# EasyEDA Pro project RN8302B-c8t6 V3.1.eprj, schematic Schematic1 (continued)
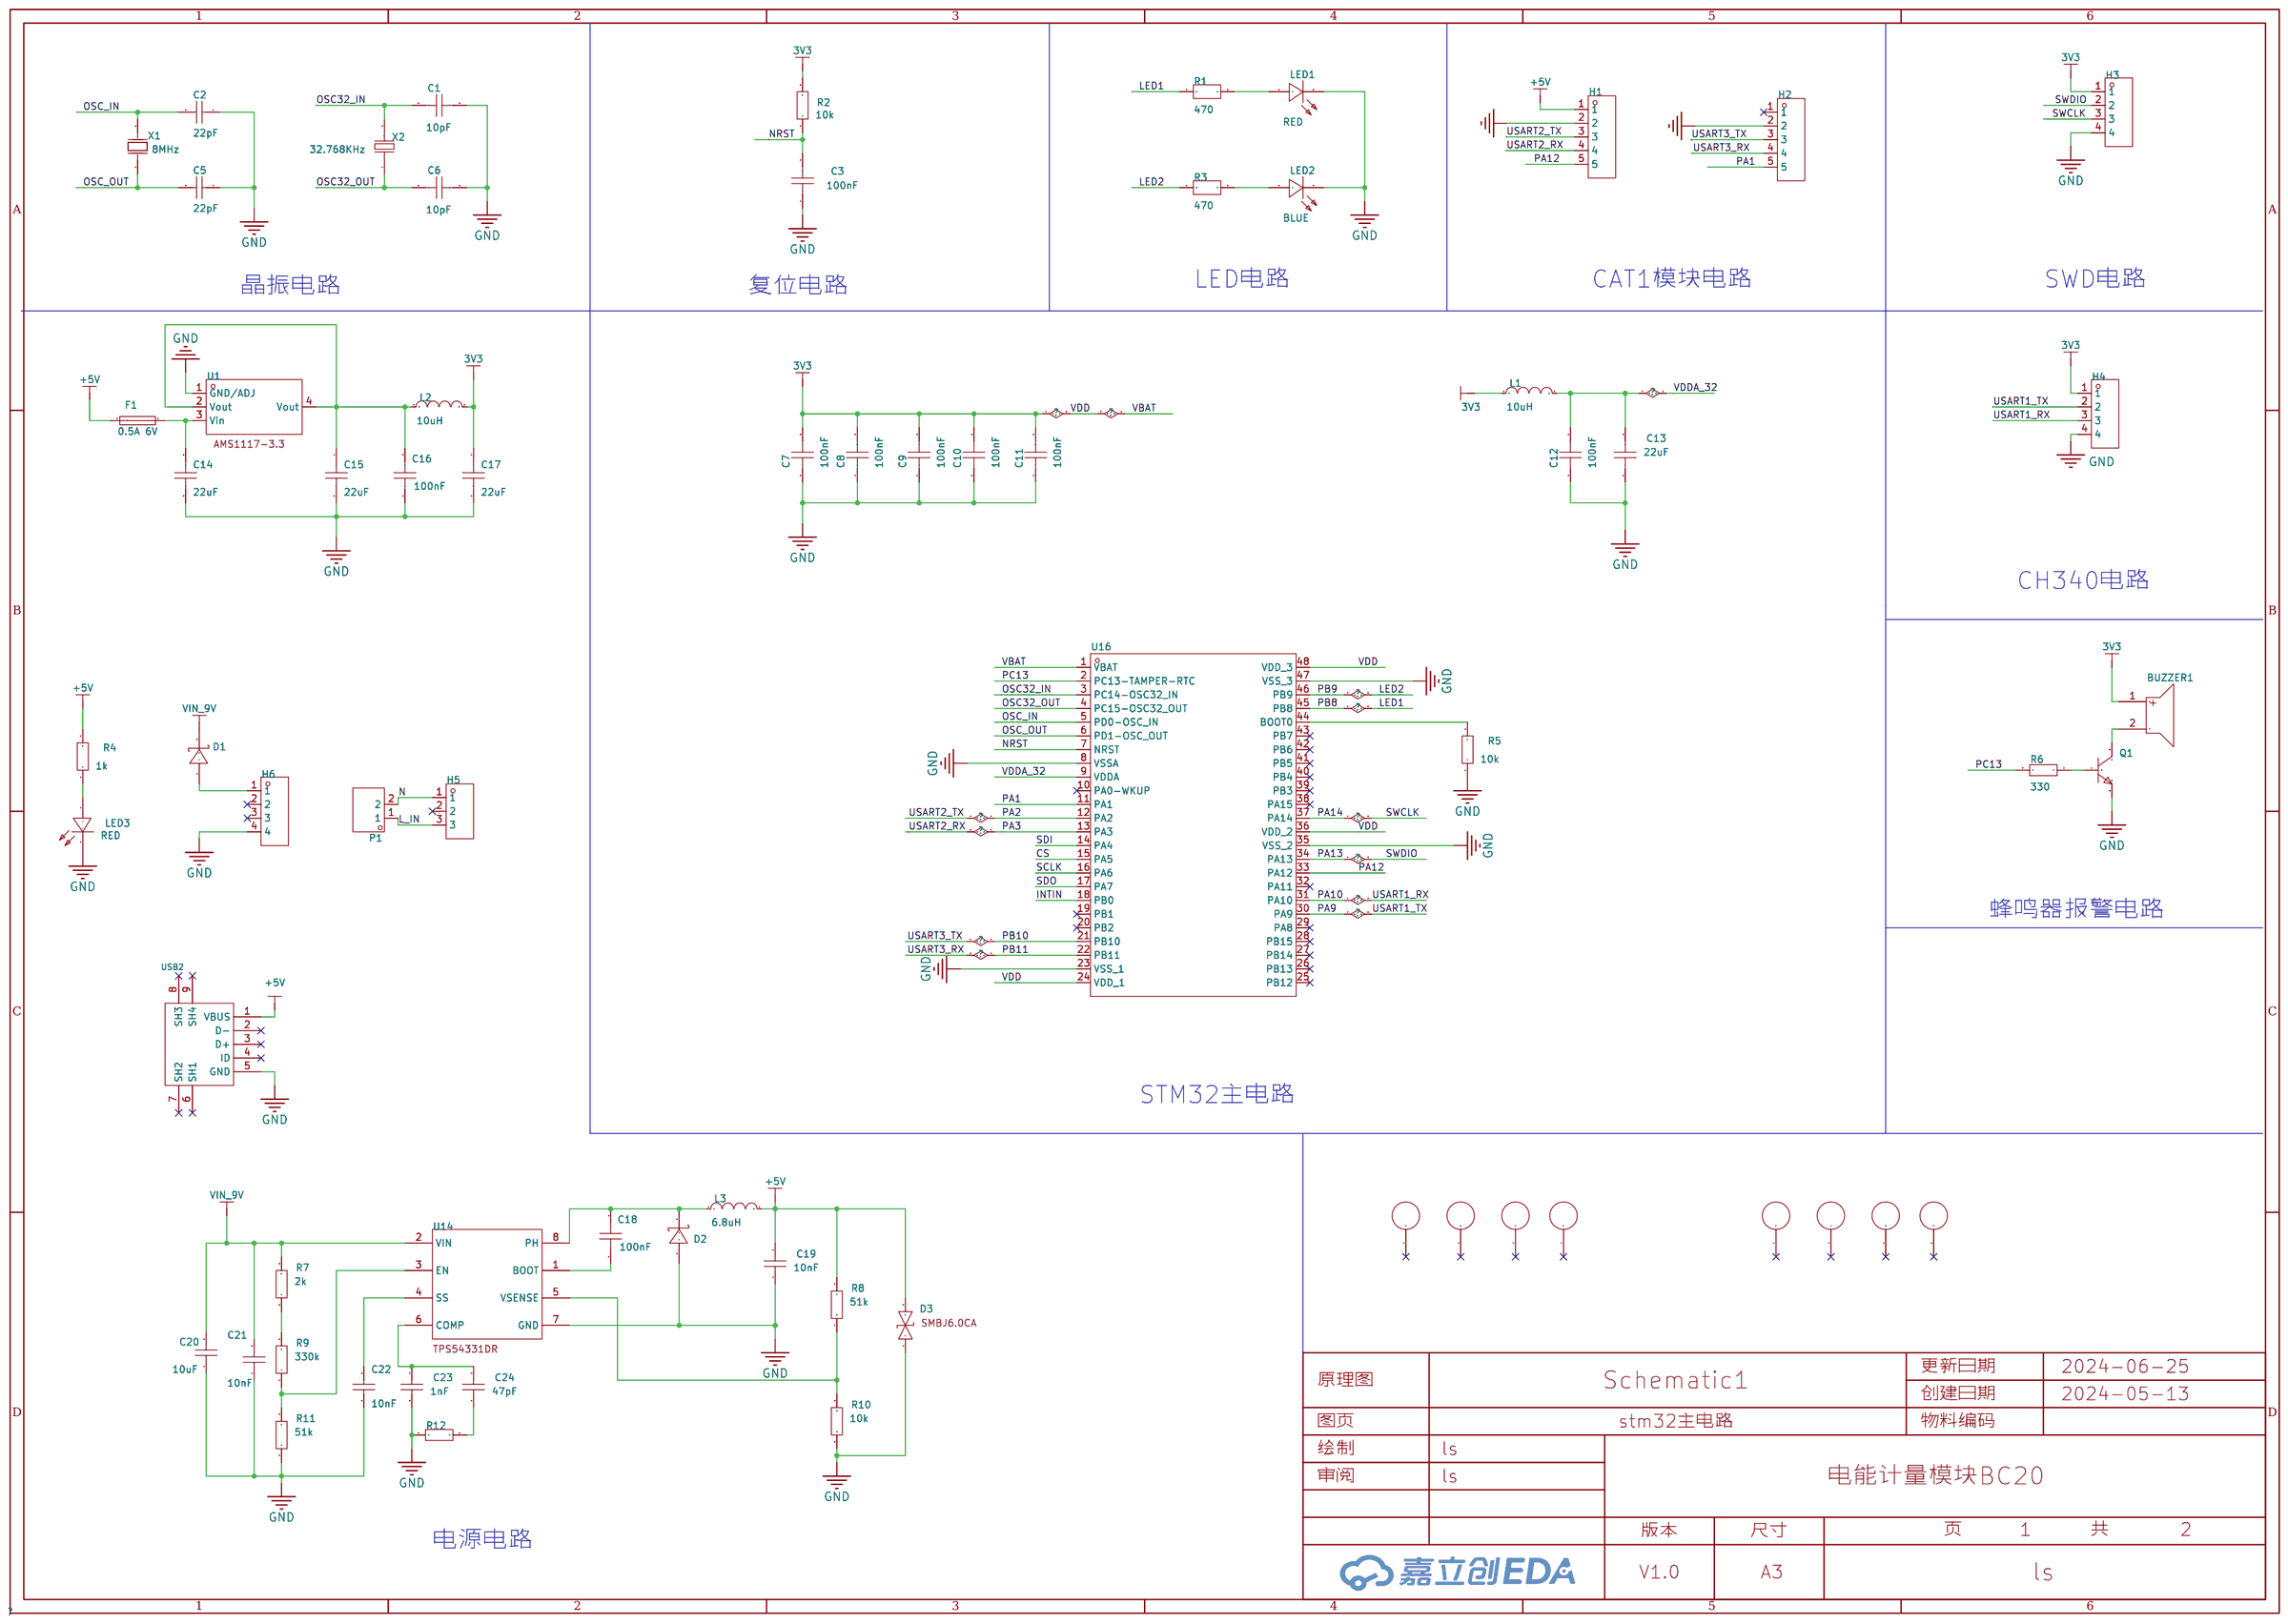
[diagram p0: stm32主电路]
## Library data of the parts (continued)
R32-R37 R42-R47 R52-R57 = 0603WAF3302T5E: 电阻类型:厚膜电阻;阻值:33kΩ;精度:±1%;功率:100mW;最大工作电压:75V;温度系数:±100ppm/℃;; LCSC Part Name: 33kΩ ±1% 100mW 厚膜电阻; Supplier Part: C4216; Manufacturer: UNI-ROYAL(厚声); Supplier Footprint: 0603; JLCPCB Part Class: 基础库; Datasheet: https://atta.szlcsc.com/upload/public/pdf/source/20200306/C422600_1E6D84923E4A46A82E41ADD87F860B5C.pdf; Supplier: LCSC; Type: 厚膜电阻; Tolerance: ±1%; Power(Watts): 100mW; Overload Voltage (Max): 75V; Temperature Coefficient: ±100ppm/℃; Operating Temperature Range: -55℃~+155℃
R38 R39 R48 R49 R58 R59 = 0603WAF499JT5E: 电阻类型:厚膜电阻;阻值:49.9Ω;精度:±1%;功率:100mW;最大工作电压:75V;温度系数:±100ppm/℃;; LCSC Part Name: 49.9Ω ±1% 100mW 厚膜电阻; Supplier Part: C23185; Manufacturer: UNI-ROYAL(厚声); Supplier Footprint: 0603; JLCPCB Part Class: 基础库; Datasheet: https://atta.szlcsc.com/upload/public/pdf/source/20200306/C422600_1E6D84923E4A46A82E41ADD87F860B5C.pdf; Supplier: LCSC; Type: 厚膜电阻; Tolerance: ±1%; Power(Watts): 100mW; Overload Voltage (Max): 75V; Temperature Coefficient: ±100ppm/℃; Operating Temperature Range: -55℃~+155℃
U17 = RN8302B: Supplier Part: C84227; Manufacturer: 锐能微; Supplier Footprint: LQFP-44(10x10); JLCPCB Part Class: 扩展库; Datasheet: https://atta.szlcsc.com/upload/public/pdf/source/20230411/DF1CD6921FB40C40BE8810E1BF055CC2.pdf; Supplier: LCSC
X5 = X49SD8192MSD2SC-1: 晶振类型:直插晶振;频率:8.192MHz;常温频差:±20ppm;外接负载电容:20pF;频率稳定度(全温):±30ppm;; LCSC Part Name: 8.192MHz ±20ppm 20pF; Supplier Part: C34693; Manufacturer: YXC(扬兴晶振); Supplier Footprint: HC-49S; JLCPCB Part Class: 扩展库; Datasheet: https://atta.szlcsc.com/upload/public/pdf/source/20240329/977D7F2434F98B2BE33270BB9FF3D86D.pdf; Supplier: LCSC; Crystal Type: 直插晶振; Normal temperature Frequency Tolerance: ±20ppm; External load capacitor: 20pF; Frequency Stability(Full temperature range): ±30ppm; Operating Temperature: -20℃~+70℃
BUZZER1 = KXG0903C3: LCSC Part Name: 蜂鸣器; Supplier Part: C1122357; Manufacturer: KINGSTATE(志丰电子); Supplier Footprint: 插件; JLCPCB Part Class: Extended Part; Datasheet: https://atta.szlcsc.com/upload/public/pdf/source/20210414/C1122357_7DD89FF41C555C0A4D62A25698007102.pdf; Supplier: LCSC
C1 C6 = C2012C0G1H100DT000N: 容值:10pF;精度:±0.5pF;额定电压:50V;温度系数:C0G;; LCSC Part Name: 10pF ±0.5pF 50V; Supplier Part: C338017; Manufacturer: TDK; Supplier Footprint: 0805; JLCPCB Part Class: Extended Part; Datasheet: https://atta.szlcsc.com/upload/public/pdf/source/20181129/C338017_E805D6379BA539BB4F11BE0C94AD5704.pdf; Supplier: LCSC; Tolerance: ±0.5pF; Voltage Rated: 50V; Temperature Coefficient: C0G
C2 C5 = 0805N220J500CT: 容值:22pF;精度:±5%;额定电压:50V;温度系数:NP0;; LCSC Part Name: 22pF ±5% 50V; Supplier Part: C123642; Manufacturer: 华新科(Walsin); Supplier Footprint: 0805; JLCPCB Part Class: Extended Part; Datasheet: https://atta.szlcsc.com/upload/public/pdf/source/20200728/C123642_830473AA93168237E1ABA8D018761BF6.pdf; Supplier: LCSC; Tolerance: ±5%; Voltage Rated: 50V; Temperature Coefficient: NP0
C3 C7-C12 C16 C18 = C0805B104K500NT: 容值:100nF;精度:±10%;额定电压:50V;温度系数:X7R;; LCSC Part Name: 100nF ±10% 50V; Supplier Part: C476766; Manufacturer: TORCH(火炬); Supplier Footprint: 0805; JLCPCB Part Class: Extended Part; Datasheet: https://atta.szlcsc.com/upload/public/pdf/source/20191230/C476766_171E30D5B7F7164A8210B8E948DFBAE0.pdf; Supplier: LCSC; Tolerance: ±10%; Voltage Rated: 50V; Temperature Coefficient: X7R
C13-C15 C17 = CL21A226MOCLRNC: 容值:22uF;精度:±20%;额定电压:16V;温度系数:X5R;; LCSC Part Name: 22uF ±20% 16V; Supplier Part: C398815; Manufacturer: SAMSUNG(三星); Supplier Footprint: 0805; JLCPCB Part Class: Extended Part; Datasheet: https://atta.szlcsc.com/upload/public/pdf/source/20190620/C398815_20AAFF598B03288BF85DE788BB79EE78.pdf; Supplier: LCSC; Tolerance: ±20%; Voltage Rated: 16V; Temperature Coefficient: X5R
C19 C21 C22 = CC0603KRX7R9BB103: 容值:10nF;精度:±10%;额定电压:50V;温度系数:X7R;; LCSC Part Name: 10nF ±10% 50V; Supplier Part: C100042; Manufacturer: YAGEO(国巨); Supplier Footprint: 0603; JLCPCB Part Class: Extended Part; Datasheet: https://atta.szlcsc.com/upload/public/pdf/source/20180326/C100042_E8B0111D51DE3671A0A4A59FBCEFE81C.pdf; Supplier: LCSC; Tolerance: ±10%; Voltage Rated: 50V; Temperature Coefficient: X7R
C20 = CL31A106KBHNNNE: 容值:10uF;精度:±10%;额定电压:50V;温度系数:X5R;; LCSC Part Name: 10uF ±10% 50V; Supplier Part: C13585; Manufacturer: SAMSUNG(三星); Supplier Footprint: 1206; JLCPCB Part Class: Basic Part; Datasheet: https://atta.szlcsc.com/upload/public/pdf/source/20160103/1457707668742.pdf; Supplier: LCSC; Tolerance: ±10%; Voltage Rated: 50V; Temperature Coefficient: X5R
C23 = CC0402KRX7R9BB102: 容值:1nF;精度:±10%;额定电压:50V;温度系数:X7R;; LCSC Part Name: 1nF ±10% 50V; Supplier Part: C106205; Manufacturer: YAGEO(国巨); Supplier Footprint: 0402; JLCPCB Part Class: Extended Part; Datasheet: https://atta.szlcsc.com/upload/public/pdf/source/20171226/C106205_15142609593391205665.pdf; Supplier: LCSC; Tolerance: ±10%; Voltage Rated: 50V; Temperature Coefficient: X7R
C24 = CC0402JRNPO9BN470: 容值:47pF;精度:±5%;额定电压:50V;温度系数:NP0;; LCSC Part Name: 47pF ±5% 50V; Supplier Part: C60137; Manufacturer: YAGEO(国巨); Supplier Footprint: 0402; JLCPCB Part Class: Extended Part; Datasheet: https://atta.szlcsc.com/upload/public/pdf/source/20151203/1457707608387.pdf; Supplier: LCSC; Tolerance: ±5%; Voltage Rated: 50V; Temperature Coefficient: NP0
D1 = SS210_1: 直流反向耐压(Vr):100V;平均整流电流(Io):2A;正向压降(Vf):850mV@2A;; LCSC Part Name: 100V 2A 850mV@2A; Supplier Part: C14996; Manufacturer: MDD; Manufacturer Part: SS210; Supplier Footprint: SMA(DO-214AC); JLCPCB Part Class: Basic Part; Datasheet: https://atta.szlcsc.com/upload/public/pdf/source/20190304/C14996_C9642665EC53B919CC87DB9E28DB3D1C.pdf; Supplier: LCSC; Reverse Voltage (Vr): 100V; Average Rectified Current (Io): 2A; Forward Voltage (Vf@If): 850mV@2A
D2 = SR34_R1_00001: 直流反向耐压(Vr):40V;平均整流电流(Io):3A;正向压降(Vf):500mV@3A;; LCSC Part Name: 40V 3A 500mV@3A; Supplier Part: C282386; Manufacturer: PANJIT(强茂); Supplier Footprint: SMB(DO-214AA); JLCPCB Part Class: Extended Part; Datasheet: https://atta.szlcsc.com/upload/public/pdf/source/20190416/C282386_4851096806C28D424AA72EA535C70F53.pdf; Supplier: LCSC; Reverse Voltage (Vr): 40V; Average Rectified Current (Io): 3A; Forward Voltage (Vf@If): 500mV@3A
D3 = SMBJ6.0CA: 极性:双向;反向截止电压(Vrwm):6V;击穿电压(最小值):6.67V;峰值脉冲电流(Ipp)@10/1000s:58.3A;最大钳位电压:10.3V;; LCSC Part Name: 双向 6V; Supplier Part: C693504; Manufacturer: FTR(乔光电子); Supplier Footprint: SMB(DO-214AA); JLCPCB Part Class: Extended Part; Datasheet: https://atta.szlcsc.com/upload/public/pdf/source/20200701/C693490_2A1922FF33BB98835C22E740F3EF18EC.pdf; Supplier: LCSC; Polarity: 双向; Reverse Stand-Off Voltage (Vrwm): 6V; Breakdown Voltage (Min): 6.67V; Peak Pulse Current (Ipp)@10/1000μs: 58.3A; Maximum Clamping Voltage: 10.3V
F1 = SMD0805P050TF: 最大电压:6V;最大电流:100A;保持电流:500mA;跳闸电流:1A;消耗功率:500mW;初始态阻值(最小值):150m;跳断后阻值(最大值):850m;最大动作时间:1.5s;工作温度:-40~+85;; LCSC Part Name: 0.5A 6V 自恢复保险丝; Supplier Part: C438897; Manufacturer: PTTC(聚鼎); Supplier Footprint: 0805; JLCPCB Part Class: Extended Part; Datasheet: https://atta.szlcsc.com/upload/public/pdf/source/20191118/C438897_3D26F647CCE5F843407551593BC9D6CE.pdf; Supplier: LCSC; Operating Voltage (Max): 6V; Current Rating (Max): 100A; Hold Current: 500mA; Trip Current: 1A; Power Dissipation: 500mW; Resistance - Initial (Ri) (Min): 150m; Resistance - Post Trip (R1) (Max): 850m; Maximum Time to Trip: 1.5s; Operating Temperature: -40~+85
H1 H2 = PM254-1-05-Z-8.5: 插孔结构:1x5P;间距:2.54mm;行距:-;圆孔/方孔:方孔;安装类型:直插;排数:单排;总孔位数:5P;额定电流:3A;额定电压:-;插孔方向:顶部;塑高:8.5mm;触头材质:铜合金;工作温度范围:-40℃~+105℃;焊接温度(最大值):260℃@5S;; LCSC Part Name: 1x5P 间距:2.54mm 直插; Supplier Part: C2897368; Manufacturer: HCTL(华灿天禄); Supplier Footprint: 插件,P=2.54mm; JLCPCB Part Class: 扩展库; Datasheet: https://atta.szlcsc.com/upload/public/pdf/source/20230609/534BE42964C679BDE98E061007C4ABD6.pdf; Supplier: LCSC; Holes Structure: 1x5P; Pitch: 2.54mm; Circular Hole / Square Hole: 方孔; Mounting Type: 直插; Number of Rows: 单排; Number of Holes: 5P; Current Rating (Max): 3A; Holes Direction: 顶部; Insulation Height: 8.5mm; Contact Material: 铜合金; Operating Temperature Range: -40℃~+105℃; Soldering Temperature(Max): 260℃@5S
H3 = DZ254R-11-04-63: 间距:2.54mm;总PIN位数:4;排数:1;插针结构:1x4P;行距:-;安装类型:直插;圆针/方针:方针;额定电流:3A;额定电压:-;配合针长度:6mm;塑高:2.54mm;端接针长度:3mm;工作温度范围:-;颜色:-;; LCSC Part Name: 排针2.54 1*4P 180度 6/3; Supplier Part: C2935910; Manufacturer: DEALON(德艺隆); Supplier Footprint: 插件,P=2.54mm; JLCPCB Part Class: Extended Part; Datasheet: https://atta.szlcsc.com/upload/public/pdf/source/20211231/575FA3133C71038A037ABECAE7869EE6.pdf; Supplier: LCSC; Pitch: 2.54mm; Number of Pins: 4; Number of Rows: 1; Pin Structure: 1x4P; Mounting Type: 直插; Circluar Pins/Square Pins: 方针; Current Rating (Max): 3A; Length of Mating Pin: 6mm; Insulation Height: 2.54mm; Length of End Connection Pin: 3mm
H4 H6 = 5-146280-4: 间距:2.54mm;总PIN位数:4;排数:1;插针结构:1x4P;行距:-;安装类型:直插;圆针/方针:-;额定电流:-;额定电压:-;配合针长度:5.84mm;塑高:2.29mm;端接针长度:3.05mm;触头材质:-;工作温度范围:-;颜色:黑色;; LCSC Part Name: 2.54mm 1x4P; Supplier Part: C2895596; Manufacturer: TE Connectivity(美国泰科); Supplier Footprint: 插件,P=2.54mm; JLCPCB Part Class: Extended Part; Datasheet: https://atta.szlcsc.com/upload/public/pdf/source/20181105/C306138_0F0AE95126E9351E8C2E5E275EABEFB2.pdf; Supplier: LCSC; Pitch: 2.54mm; Number of Pins: 4; Number of Rows: 1; Pin Structure: 1x4P; Mounting Type: 直插; Length of Mating Pin: 5.84mm; Insulation Height: 2.29mm; Length of End Connection Pin: 3.05mm; Color: 黑色
H5 = Z-211-0311-0021-001: 排数:单排;总PIN位数:3;间距:2.54mm;插针结构:1x3P;行距:-;安装类型:直插;圆针/方针:方针;额定电流:-;额定电压:-;配合针长度:6mm;塑高:2.5mm;端接针长度:3mm;触头材质:黄铜;触头镀层:-;工作温度范围:-25~+105;颜色:黑色;; LCSC Part Name: 2.54mm 1x3P 直插 方针; Supplier Part: C152153; Manufacturer: Nextron(正凌); Supplier Footprint: 插件,P=2.54mm; JLCPCB Part Class: Extended Part; Datasheet: https://atta.szlcsc.com/upload/public/pdf/source/20171225/C152153_15141883742081203215.pdf; Supplier: LCSC; Number of Rows: 单排; Number of Pins: 3; Pitch: 2.54mm; Pin Structure: 1x3P; Mounting Type: 直插; Circluar Pins/Square Pins: 方针; Length of Mating Pin: 6mm; Insulation Height: 2.5mm; Length of End Connection Pin: 3mm; Contact Material: 黄铜; Operating Temperature Range: -25~+105; Color: 黑色
L1 L2 = MGFI2012D100KT-LF: 电感值:10uH;精度:±10%;额定电流:15mA;饱和电流(Isat):-;直流电阻(DCR):1.15;; LCSC Part Name: 10uH ±10% 15mA 1.15; Supplier Part: C281097; Manufacturer: microgate(麦捷科技); Supplier Footprint: 0805; JLCPCB Part Class: Extended Part; Datasheet: https://atta.szlcsc.com/upload/public/pdf/source/20181025/C281097_183358CEE34CC95446AA811DEBE652F2.pdf; Supplier: LCSC; Tolerance: ±10%; Rated Current: 15mA; DC Resistance (DCR): 1.15
L3 = SLF6045T-6R8N2R0-3PF: 电感值:6.8uH;精度:±30%;额定电流:-;直流电阻(DCR):42.9m;; LCSC Part Name: 6.8uH ±30% 42.9m; Supplier Part: C138486; Manufacturer: TDK; Supplier Footprint: SMD; JLCPCB Part Class: Extended Part; Datasheet: https://atta.szlcsc.com/upload/public/pdf/source/20171113/C138486_15105611407371115561.pdf; Supplier: LCSC; Tolerance: ±30%; DC Resistance (DCR): 42.9m
LED1-LED3 = SZYY0805R: 发光颜色:红灯;二极管配置:-;透镜颜色:无色透明;主波长:615nm~630nm;峰值波长:645nm;色温:-;光通量(25时):-;测试电流:10mA;正向电压(VF):2.4V;发光强度:120mcd;功率:40mW;发光角度:120°;安装方式:-;工作温度:-40~+85;; LCSC Part Name: 红灯; Supplier Part: C434431; Manufacturer: yongyu(永裕光电); Supplier Footprint: 0805; JLCPCB Part Class: Extended Part; Datasheet: https://atta.szlcsc.com/upload/public/pdf/source/20191204/C434431_431C171B758FE4C37FA40B1B295AA7AB.pdf; Supplier: LCSC; Emitted Color: 红灯; Lens Color: 无色透明; Dominant Wavelength: 615nm~630nm; Peak Wavelength: 645nm; Forward Current: 10mA; Forward Voltage (VF): 2.4V; Luminous Intensity: 120mcd; Power Dissipation: 40mW; Viewing Angle: 120°; Operating Temperature: -40~+85
P1 = WJ15EDGRC-3.81-2P: 连接器类型:板端/插座-闭口;间距:3.81mm;排数:1;每排PIN数:2;安装方式:弯针;颜色:绿色;; LCSC Part Name: 板端/插座-闭口 3.81mm 排数:1 每排P数:2 弯针; Supplier Part: C8387; Manufacturer: KANGNEX(康奈克斯电气); Supplier Footprint: 弯插,P=3.81mm; JLCPCB Part Class: Extended Part; Datasheet: https://atta.szlcsc.com/upload/public/pdf/source/20191225/C8387_8EBAF10345D2762F0167C8753398EEFA.pdf; Supplier: LCSC; Connector Type: 板端/插座-闭口; Pitch: 3.81mm; Number of Rows: 1; Number of PINs Per Row: 2; Mounting Style: 弯针; Color: 绿色
Q1 = S8050_C2891804: Supplier Part: C2891804; Manufacturer: YONGYUTAI(永裕泰); Supplier Footprint: SOT-23; JLCPCB Part Class: Extended Part; Datasheet: https://atta.szlcsc.com/upload/public/pdf/source/20210901/5347316A10609C628D4D69AE01446E5B.pdf; Supplier: LCSC
R1 R3 = 0805W8F1002T5E_1: 电阻类型:厚膜电阻;阻值:10k;精度:±1%;功率:1/8W;温度系数:±100ppm/;最大工作电压:150V;工作温度范围:-55~+155;; LCSC Part Name: 10k ±1%; Supplier Part: C38522; Manufacturer: UNI-ROYAL(厚声); Manufacturer Part: 0805W8F1002T5E; Supplier Footprint: 0805; JLCPCB Part Class: Extended Part; Datasheet: https://atta.szlcsc.com/upload/public/pdf/source/20200306/C422600_1E6D84923E4A46A82E41ADD87F860B5C.pdf; Supplier: LCSC; Type: 厚膜电阻; Tolerance: ±1%; Power(Watts): 1/8W; Temperature Coefficient: ±100ppm/; Overload Voltage (Max): 150V; Operating Temperature Range: -55~+155
R2 R4 R5 = 0805W8F1002T5E: 电阻类型:厚膜电阻;阻值:10k;精度:±1%;功率:1/8W;温度系数:±100ppm/;最大工作电压:150V;工作温度范围:-55~+155;; LCSC Part Name: 10k ±1% 1/8W; Supplier Part: C17414; Manufacturer: UNI-ROYAL(厚声); Supplier Footprint: 0805; JLCPCB Part Class: Basic Part; Datasheet: https://atta.szlcsc.com/upload/public/pdf/source/20200306/C422600_1E6D84923E4A46A82E41ADD87F860B5C.pdf; Supplier: LCSC; Type: 厚膜电阻; Tolerance: ±1%; Power(Watts): 1/8W; Temperature Coefficient: ±100ppm/; Overload Voltage (Max): 150V; Operating Temperature Range: -55~+155
R6 = 0805W8F1002T5E_4: 电阻类型:厚膜电阻;阻值:10k;精度:±1%;功率:1/8W;温度系数:±100ppm/;最大工作电压:150V;工作温度范围:-55~+155;; LCSC Part Name: 10k ±1% 1/8W; Supplier Part: C17414; Manufacturer: UNI-ROYAL(厚声); Manufacturer Part: 0805W8F1002T5E; Supplier Footprint: 0805; JLCPCB Part Class: Basic Part; Datasheet: https://atta.szlcsc.com/upload/public/pdf/source/20200306/C422600_1E6D84923E4A46A82E41ADD87F860B5C.pdf; Supplier: LCSC; Type: 厚膜电阻; Tolerance: ±1%; Power(Watts): 1/8W; Temperature Coefficient: ±100ppm/; Overload Voltage (Max): 150V; Operating Temperature Range: -55~+155
R7 = 0805W8F2001T5E: 电阻类型:厚膜电阻;阻值:2k;精度:±1%;功率:1/8W;温度系数:±100ppm/;最大工作电压:150V;工作温度范围:-55~+155;; LCSC Part Name: 2k ±1% 1/8W; Supplier Part: C17604; Manufacturer: UNI-ROYAL(厚声); Supplier Footprint: 0805; JLCPCB Part Class: Basic Part; Datasheet: https://atta.szlcsc.com/upload/public/pdf/source/20200306/C422600_1E6D84923E4A46A82E41ADD87F860B5C.pdf; Supplier: LCSC; Type: 厚膜电阻; Tolerance: ±1%; Power(Watts): 1/8W; Temperature Coefficient: ±100ppm/; Overload Voltage (Max): 150V; Operating Temperature Range: -55~+155
R8 R11 = 0805W8F5102T5E: 电阻类型:厚膜电阻;阻值:51k;精度:±1%;功率:1/8W;温度系数:±100ppm/;最大工作电压:150V;工作温度范围:-55~+155;; LCSC Part Name: 51k ±1%; Supplier Part: C17737; Manufacturer: UNI-ROYAL(厚声); Supplier Footprint: 0805; JLCPCB Part Class: Basic Part; Datasheet: https://atta.szlcsc.com/upload/public/pdf/source/20200306/C422600_1E6D84923E4A46A82E41ADD87F860B5C.pdf; Supplier: LCSC; Type: 厚膜电阻; Tolerance: ±1%; Power(Watts): 1/8W; Temperature Coefficient: ±100ppm/; Overload Voltage (Max): 150V; Operating Temperature Range: -55~+155
R9 = 0805W8F3303T5E: 电阻类型:厚膜电阻;阻值:330k;精度:±1%;功率:1/8W;温度系数:±100ppm/;最大工作电压:150V;工作温度范围:-55~+155;; LCSC Part Name: 330k ±1%; Supplier Part: C17629; Manufacturer: UNI-ROYAL(厚声); Supplier Footprint: 0805; JLCPCB Part Class: Basic Part; Datasheet: https://atta.szlcsc.com/upload/public/pdf/source/20200306/C422600_1E6D84923E4A46A82E41ADD87F860B5C.pdf; Supplier: LCSC; Type: 厚膜电阻; Tolerance: ±1%; Power(Watts): 1/8W; Temperature Coefficient: ±100ppm/; Overload Voltage (Max): 150V; Operating Temperature Range: -55~+155
R10 = 0603WAF1002T5E: 电阻类型:厚膜电阻;阻值:10k;精度:±1%;功率:1/10W;温度系数:±100ppm/;最大工作电压:75V;工作温度范围:-55~+155;; LCSC Part Name: 10k ±1% 1/10W; Supplier Part: C25804; Manufacturer: UNI-ROYAL(厚声); Supplier Footprint: 0603; JLCPCB Part Class: Basic Part; Datasheet: https://atta.szlcsc.com/upload/public/pdf/source/20200306/C422600_1E6D84923E4A46A82E41ADD87F860B5C.pdf; Supplier: LCSC; Type: 厚膜电阻; Tolerance: ±1%; Power(Watts): 1/10W; Temperature Coefficient: ±100ppm/; Overload Voltage (Max): 75V; Operating Temperature Range: -55~+155
R12 = 0603WAF3002T5E: LCSC Part Name: 30K(3002) ±1% 编带; Supplier Part: C22984; Manufacturer: UNI-ROYAL(厚声); Supplier Footprint: 0603; JLCPCB Part Class: Basic Part; Datasheet: https://atta.szlcsc.com/upload/public/pdf/source/20170920/C22984_1505901017418982371.pdf; Supplier: LCSC
U1 = AMS1117-3.3_1: 输出类型:固定;输出极性:正;输出通道数:1;最大输入电压:-;输出电压:3.3V;压差:1.3V@(800mA);静态电流(地电流):-;输出电流:1A;电源纹波抑制比(PSRR):72dB@(120Hz);噪声:-;特性:-;工作温度:-;; LCSC Part Name: Vout=3.3V 1A 72dB@(120Hz); Supplier Part: C6186; Manufacturer: 美国AMS; Manufacturer Part: AMS1117-3.3; Supplier Footprint: SOT-223; JLCPCB Part Class: Basic Part; Datasheet: https://atta.szlcsc.com/upload/public/pdf/source/20180727/C6186_7A095716F0823C02F1997A905E26C086.pdf; Supplier: LCSC; Output Type: 固定; Output Polarity: 正; Number of Outputs: 1; Output Voltage: 3.3V; Dropout Voltage: 1.3V@(800mA); Output Current: 1A; Power Supply Rejection Ratio (PSRR): 72dB@(120Hz)
U3-U10 = 铜柱M3*5+6: 螺柱类型:单通螺柱;公称直径:M3;螺距:-;长度:11mm;执行标准:-;强度等级:-;材料:-;表面处理:-;; Supplier Part: C87703; Manufacturer: 国产; Supplier Footprint: M3*5+6; JLCPCB Part Class: Extended Part; Datasheet: https://atta.szlcsc.com/upload/public/pdf/source/20180629/C87703_D0202CF0C285C70F41F1E6F27424EC8C.pdf; Supplier: LCSC; Bolts Type: 单通螺柱; Nominal Diameter: M3; Length: 11mm
U14 = TPS54331DR: 功能类型:降压型;同步整流:-;输出通道数:-;拓扑结构:-;输入电压:-;输出电流(最大值):-;开关频率:-;; LCSC Part Name: 降压型; Supplier Part: C9865; Manufacturer: TI(德州仪器); Supplier Footprint: SOIC-8_150mil; JLCPCB Part Class: Basic Part; Datasheet: https://atta.szlcsc.com/upload/public/pdf/source/20121112/1457706556448.pdf; Supplier: LCSC; Function: 降压型
U16 = STM32F103C8T6_1: CPU内核:ARM Cortex-M3;CPU最大主频:72MHz;程序存储容量:64KB;程序存储器类型:FLASH;RAM总容量:20KB;GPIO端口数量:37;; LCSC Part Name: ARM Cortex-M3 72MHz MSL=3; Supplier Part: C8734; Manufacturer: ST(意法半导体); Supplier Footprint: LQFP-48(7x7); JLCPCB Part Class: Basic Part; Datasheet: https://atta.szlcsc.com/upload/public/pdf/source/20220812/8363ACEC51AD55ECEB84799464F7CB85.pdf; Supplier: LCSC; CPU Core: ARM Cortex-M3; CPU Maximum Speed: 72MHz; Operating Voltage Range: 2V~3.6V; Program Storage Size: 64KB; Program Memory Type: FLASH; RAM Size: 20KB; GPIO Ports Number: 37; ADC (Bit): 12bit; Universal Serial Bus: 有; Peripheral/Function: 看门狗；DMA；看门狗；片载温度传感器; Watchdog: 有; Infrared Data Association: 有; Low-Voltage Detect: 有; Direct Memory Access: 有; Internal Oscillator: 有; Operating Temperature Range: -40~+85
USB2 = MicroXNJ_2: 连接器类型:Micro-B;标准:USB 2.0;公母:母座;触点数量:5P;端口数量:1;安装方式:卧贴;额定电流 - 电源:1A;工作温度范围:-20~+85;; LCSC Part Name: Micro-B 母座 卧贴 小牛角有柱 卷边 编带; Supplier Part: C404969; Manufacturer: SHOU HAN(首韩); Supplier Footprint: SMD; JLCPCB Part Class: Extended Part; Datasheet: https://atta.szlcsc.com/upload/public/pdf/source/20220415/2494EDFF499AF6F852F7C820374B6AF3.pdf; Supplier: LCSC; Connector Type: Micro-B; Standard: USB 2.0; Gender: 母座; Number of Contacts: 5P; Number of Ports: 1; Mounting Style: 卧贴; Current Rating - Power (Max): 1A; Operating Temperature Range: -20~+85
X1 = 49SAC08000∞2060: LCSC Part Name: 8MHZ PF 20PPM; Supplier Part: C443528; Manufacturer: JGHC(晶光华); Manufacturer Part: 49SAC080002060; Supplier Footprint: HC-49S; JLCPCB Part Class: Extended Part; Datasheet: https://atta.szlcsc.com/upload/public/pdf/source/20191104/C443528_53437C9383E35AFF794C091326191D62.pdf; Supplier: LCSC
X2 = DT-38 32.768KHz: 晶振类型:-;频率:-;频率公差:-;频率稳定度:-;负载电容:-;工作温度:-;; LCSC Part Name: 32.768KHz 12.5PF 20ppm; Supplier Part: C93228; Manufacturer: KDS大真空; Supplier Footprint: DT-38; JLCPCB Part Class: Extended Part; Datasheet: https://atta.szlcsc.com/upload/public/pdf/source/20170103/1483440002783.pdf; Supplier: LCSC

## Nets
3V3: BUZZER1.1 C7.2 C8.2 C9.2 C10.2 C11.2 C17.1 C31.1 C33.2 H3.1 H4.1 L1.1 L2.2 R2.2 R14.1 R16.2 R19.1 U16.1(VBAT) U16.24(VDD_1) U16.36(VDD_2) U16.48(VDD_3) U17.28(DVCC) U17.40(DVCC) U17.41(RB) U17.42(PM)
+5V: C19.2 D3.2 F1.2 H1.1 L3.2 R4.2 R8.2 USB2.1(VBUS)
GND: C1.1 C2.1 C3.1 C5.1 C6.1 C7.1 C8.1 C9.1 C10.1 C11.1 C12.1 C13.1 C14.2 C15.2 C16.1 C17.2 C19.1 C20.1 C21.1 C22.1 C23.1 C26.2 C28.2 C29.2 C30.2 C31.2 C32.2 C33.1 C34.1 C35.1 C36.1 C37.1 C38.1 C39.1 C40.2 C41.1 C42.2 C43.1 C44.2 C45.1 C46.2 C47.1 C48.2 C49.1 C50.2 C51.1 C52.2 D2.2(A) D3.1 H1.2 H2.2 H3.4 H4.4 H6.4 LED1.2(-) LED2.2(-) LED3.2(-) Q1.2(E) R5.1 R10.1 R11.1 R12.2 R20.1 R21.2 R24.1 R25.2 R28.1 R29.2 R38.1 R39.2 R48.1 R49.2 R58.1 R59.2 R62.1 R63.2 U1.1(GND/ADJ) U14.7(GND) U16.8(VSSA) U16.23(VSS_1) U16.35(VSS_2) U16.47(VSS_3) U17.6(AGND) U17.20(RA) U17.21(NC) U17.29(DGND) U17.39(DGND) U17.43(RC) U17.44(NC) USB2.5(GND)
VDDA: C32.1 C34.2 R14.2 U17.9(AVCC)
VDDA_32: C12.2 C13.2 L1.2 U16.9(VDDA)
VIN_9V: C20.2 C21.2 D1.1(K) R7.2 U14.2(VIN)
CLK: C36.2 R17.1 U17.33(SCLK)
CS: R16.1 U16.15(PA5) U17.34(SCSN)
DI: C35.2 R15.1 U17.35(SDI)
DO: C37.2 R18.1 U17.32(SDO)
I1N: C40.1 R23.2 U17.5(IAN)
I1N_IN: CN5.2 R21.1 R23.1
I1P: C39.2 R22.2 U17.4(IAP)
I1P_IN: CN5.1 R20.2 R22.1
I2N: C42.1 R27.2 U17.8(IBN)
I2N_IN: CN5.4 R25.1 R27.1
I2P: C41.2 R26.2 U17.7(IBP)
I2P_IN: CN5.3 R24.2 R26.1
I3N: C44.1 R31.2 U17.11(ICN)
I3N_IN: CN5.6 R29.1 R31.1
I3P: C43.2 R30.2 U17.10(ICP)
I3P_IN: CN5.5 R28.2 R30.1
INN: C52.1 R65.2 U17.19(INN)
INN_IN: CN5.8 R63.1 R65.1
INP: C51.2 R64.2 U17.18(INP)
INP_IN: CN5.7 R62.2 R64.1
INTIN: U16.18(PB0) U17.31(INTN)
L_IN: H5.3 P1.1
LED1: R1.1 U16.45(PB8)
LED2: R3.1 U16.46(PB9)
N: H5.1 P1.2
NRST: C3.2 R2.1 U16.7(NRST)
OSC32_IN: C1.2 U16.3(PC14-OSC32_IN) X2.2
OSC32_OUT: C6.2 U16.4(PC15-OSC32_OUT) X2.1
OSC_IN: C2.2 U16.5(PD0-OSC_IN) X1.2(OSC2)
OSC_OUT: C5.2 U16.6(PD1-OSC_OUT) X1.1(OSC1)
PA1: H2.5 U16.11(PA1)
PA2: H1.3 U16.12(PA2)
PA3: H1.4 U16.13(PA3)
PA9: H4.2 U16.30(PA9)
PA10: H4.3 U16.31(PA10)
PA12: H1.5 U16.33(PA12)
PA13: H3.2 U16.34(PA13)
PA14: H3.3 U16.37(PA14)
PB10: H2.3 U16.21(PB10)
PB11: H2.4 U16.22(PB11)
PC13: R6.2 U16.2(PC13-TAMPER-RTC)
RSTN: C38.2 R19.2 U17.27(RSTN)
SCLK: R17.2 U16.16(PA6)
SDI: R15.2 U16.14(PA4)
SDO: R18.2 U16.17(PA7)
UA-IN: P2.1 R37.2
UA-OUT: L4.2 P2.2
UB-IN: P3.1 R47.2
UB-OUT: L5.2 P3.2
UC-IN: P4.1 R57.2
UC-OUT: L6.2 P4.2
VAN: C46.1 R41.2 U17.13(VAN)
VAP: C45.2 R40.2 U17.12(VAP)
VBN: C48.1 R51.2 U17.15(VBN)
VBP: C47.2 R50.2 U17.14(VBP)
VCN: C50.1 R61.2 U17.17(VCN)
VCP: C49.2 R60.2 U17.16(VCP)
XI: C30.1 R13.1 U17.37(XI) X5.2(OSC2)
XO: C29.1 R13.2 U17.36(XO) X5.1(OSC1)
$1N22559: LED1.1(+) R1.2
$1N22560: LED2.1(+) R3.2
$1N22574: C14.1 F1.1 U1.3(Vin)
$1N22575: C15.1 C16.2 L2.1 U1.2(Vout) U1.4(Vout)
$1N22612: LED3.1(+) R4.1
$1N22614: R7.1 R9.2
$1N22615: R9.1 R11.2 U14.3(EN)
$1N22617: C22.2 U14.4(SS)
$1N22619: C18.1 U14.1(BOOT)
$1N22620: C23.2 C24.2 U14.6(COMP)
$1N22621: C24.1 R12.1
$1N22623: R8.1 R10.2 U14.5(VSENSE)
$1N22626: C18.2 D2.1(K) L3.1 U14.8(PH)
$1N22649: D1.2(A) H6.1
$1N22650: BUZZER1.2 Q1.3(C)
$1N22653: Q1.1(B) R6.1
$1N22719: R5.2 U16.44(BOOT0)
$2N4939: R36.2 R37.1
$2N4942: R35.2 R36.1
$2N4945: R34.2 R35.1
$2N4948: R33.2 R34.1
$2N4951: R32.2 R33.1
$2N4958: L4.4 R39.1 R41.1
$2N5672: R46.2 R47.1
$2N5674: R45.2 R46.1
$2N5676: R44.2 R45.1
$2N5678: R43.2 R44.1
$2N5680: R42.2 R43.1
$2N6267: R56.2 R57.1
$2N6269: R55.2 R56.1
$2N6271: R54.2 R55.1
$2N6273: R53.2 R54.1
$2N6275: R52.2 R53.1
$2N11088: L4.3 R38.2 R40.1
$2N11115: L4.1 R32.1
$2N11127: L5.4 R49.1 R51.1
$2N11134: L5.3 R48.2 R50.1
$2N11141: L5.1 R42.1
$2N11154: L6.3 R58.2 R60.1
$2N11165: L6.4 R59.1 R61.1
$2N11172: L6.1 R52.1
$2N20660: C26.1 C28.1 U17.3(REFV)

Not connected (* = marked no-connect by the designer): H2 1*; H5 2*; H6 2* 3*; U3 1*; U4 1*; U5 1*; U6 1*; U7 1*; U8 1*; U9 1*; U10 1*; U16 10(PA0-WKUP)* 19(PB1)* 20(PB2)* 25(PB12)* 26(PB13)* 27(PB14)* 28(PB15)* 29(PA8)* 32(PA11)* 38(PA15)* 39(PB3)* 40(PB4)* 41(PB5)* 42(PB6)* 43(PB7)*; U17 1(NC)* 2(NC)* 22(CTT)* 23(CF4)* 24(CF3)* 25(CF2)* 26(CF1)* 30(NC)* 38(VO)*; USB2 2(D-)* 3(D+)* 4(ID)* 6(SH1)* 7(SH2)* 8(SH3)* 9(SH4)*

## Notes on the sheets
sheet 1
- LED电路
- CAT1模块电路
- SWD电路
- 晶振电路
- 复位电路
- CH340电路
- 蜂鸣器报警电路
- STM32主电路
- 电源电路
sheet 2
- 晶振电路
- 电流采样
- RN8302B芯片
- SPI通信
- 电压采样电路
